# EasyEDA Pro project Archive.eprj, board ALU2.0
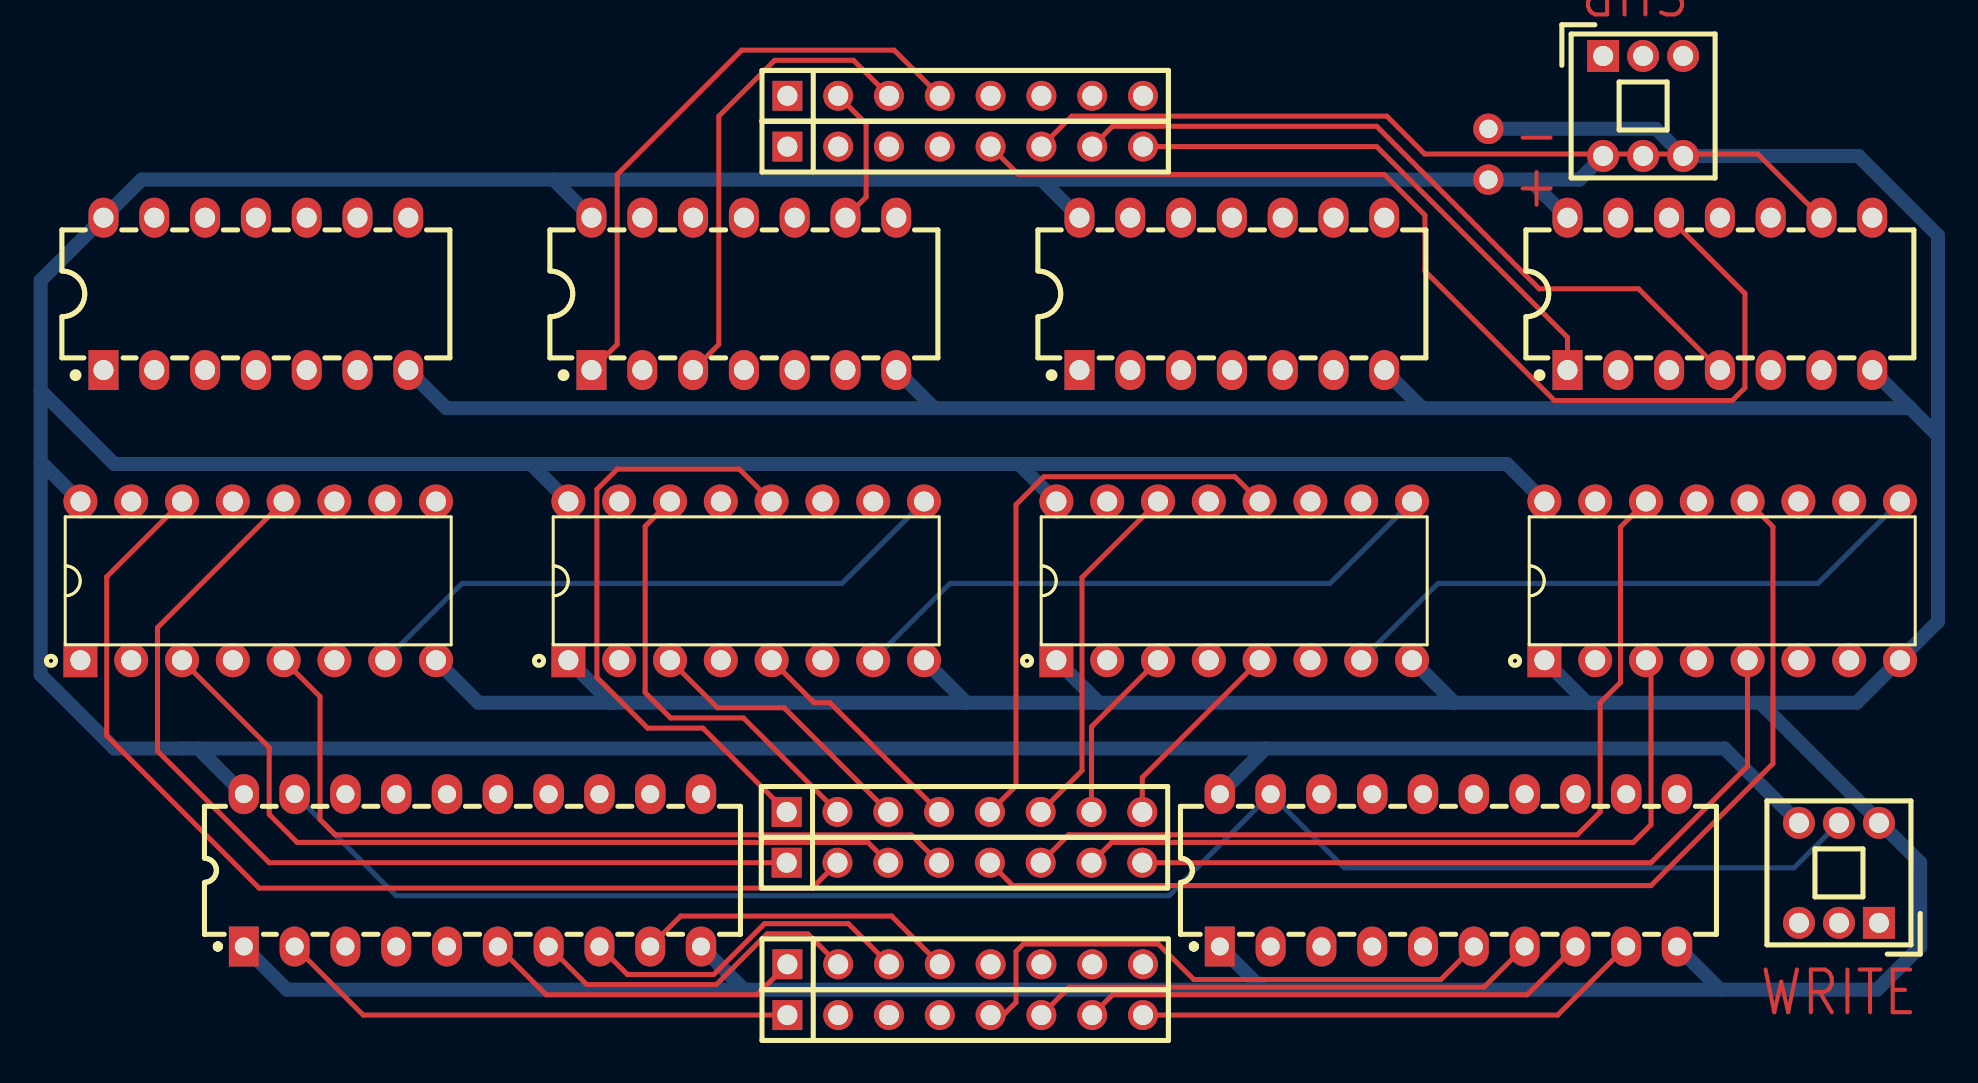
[diagram p14: board, top side]
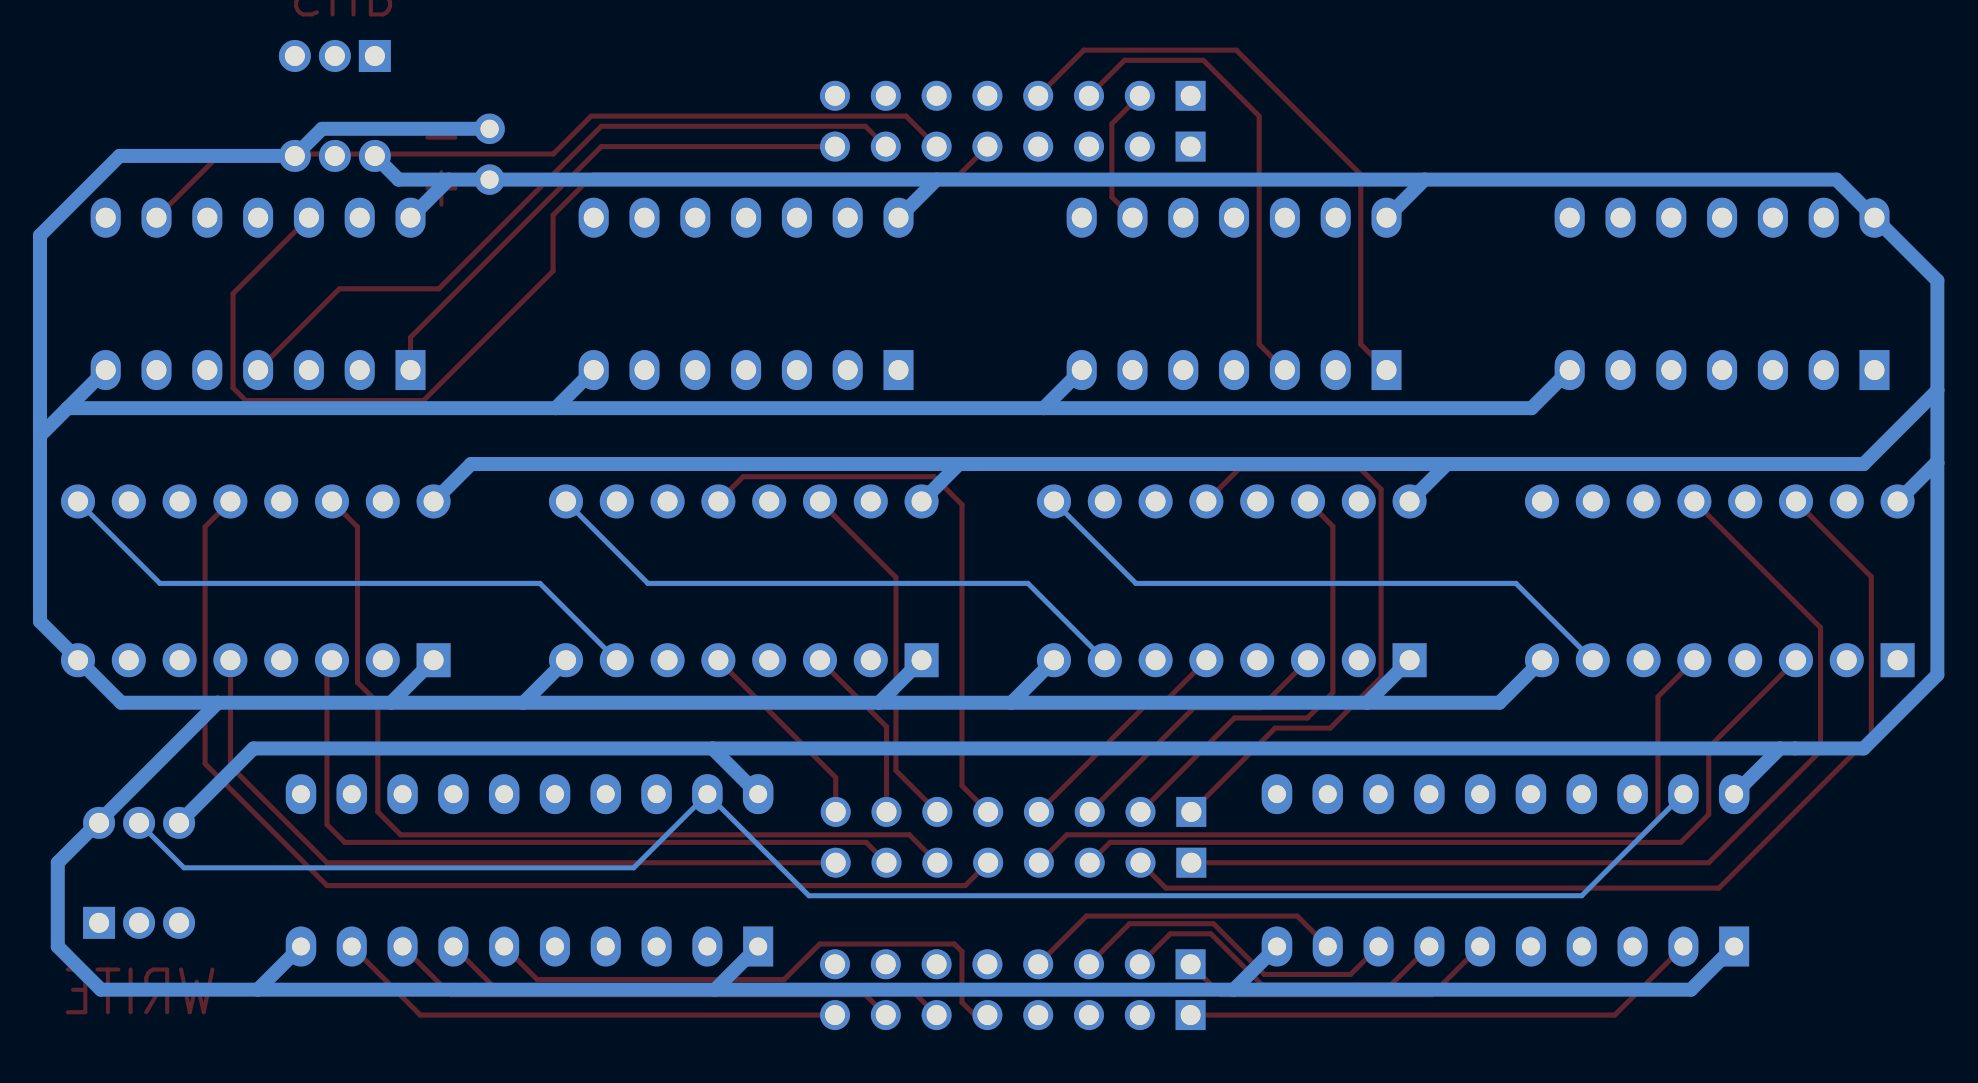
[diagram p15: board, bottom side, seen from below]

No outline. copper layers: Top Layer, Inner1, Inner2, Bottom Layer. Coordinates in mm from the lowest, leftmost part position.
Stack: Top Layer 0.035mm / Dielectric1 1.51mm FR4 er 4.5 / Inner1 0.035mm / Dielectric2 0.48mm PP er 4.5 / Inner2 0.035mm / Dielectric3 0.48mm PP er 4.5 / Bottom Layer 0.035mm

## Design rules (mm)
template: JLCPCB Capability(Two Layers Board)
spacing copperThickness1oz (default): track to track 0.102, other pairs 0.152 to 0.3
spacing copperThickness2oz: track to track 0.203, other pairs 0.152 to 0.3
track width copperThickness1oz (default): min 0.127, default 0.254, max 2.54
track width copperThickness2oz: min 0.203, default 0.254, max 2.54
differential pair differentialPair (default): width min 0.127, default 0.254, max 2.54; gap min 0.152, default 0.152
via viaSize (default): diameter min 0.5, default 0.61, max 10; hole min 0.3, default 0.305, max 6.3

## Placement (name value [footprint] x y rotation side)
NOREF  -  [Pad_e542]  61.63 44.32 270 top
NOREF#2  -  [Pad_e543]  61.63 41.78 270 top
SW2  -  [SW-TH_6P-L7.0-W7.0-P2.00]  69.36 45.47 90 top
SW2#2  -  [SW-TH_6P-L7.0-W7.0-P2.00]  79.15 7.11 270 top
U5  -  [DIP-20_L26.8-W6.4-P2.54-LS7.6-BL]  59.63 7.24 0 top
U5#2  -  [DIP-20_L26.8-W6.4-P2.54-LS7.6-BL]  10.83 7.24 0 top
U10  -  [HDR-TH_8P-P2.54-V-M-4]  35.47 45.97 0 top
U10#2  -  [HDR-TH_8P-P2.54-V-M-4]  35.47 43.43 0 top
U10#3  -  [HDR-TH_8P-P2.54-V-M-4]  35.43 7.62 0 top
U10#4  -  [HDR-TH_8P-P2.54-V-M-4]  35.43 10.16 0 top
U10#5  -  [HDR-TH_8P-P2.54-V-M-4]  35.47 0 0 top
U10#6  -  [HDR-TH_8P-P2.54-V-M-4]  35.47 2.54 0 top
U14  -  [PDIP-14_L19.3-W6.4-P2.54-LS7.9-BL-1]  48.8 36.07 0 top
U14#2  -  [PDIP-14_L19.3-W6.4-P2.54-LS7.9-BL-1]  73.2 36.07 0 top
U14#3  -  [PDIP-14_L19.3-W6.4-P2.54-LS7.9-BL-1]  0 36.07 0 top
U14#4  -  [PDIP-14_L19.3-W6.4-P2.54-LS7.9-BL-1]  24.4 36.07 0 top
U17  -  [DIP-16_L19.3-W6.4-P2.54-LS7.94-BL]  48.92 21.72 0 top
U17#2  -  [DIP-16_L19.3-W6.4-P2.54-LS7.94-BL]  73.32 21.72 0 top
U17#3  -  [DIP-16_L19.3-W6.4-P2.54-LS7.94-BL]  0.12 21.72 0 top
U17#4  -  [DIP-16_L19.3-W6.4-P2.54-LS7.94-BL]  24.52 21.72 0 top

## Footprints (pads in the part's own frame, mm; a bottom-side part is the same pattern mirrored in y, then rotated)
DIP-16_L19.3-W6.4-P2.54-LS7.94-BL
  rect 1.7x1.7 hole 1: 1(-8.89,-3.97)
  round 1.7 hole 1: 2(-6.35,-3.97) 3(-3.81,-3.97) 4(-1.27,-3.97) 5(1.27,-3.97) 6(3.81,-3.97) 7(6.35,-3.97) 8(8.89,-3.97) 9(8.89,3.97) 10(6.35,3.97) 11(3.81,3.97) 12(1.27,3.97) 13(-1.27,3.97) 14(-3.81,3.97) 15(-6.35,3.97) 16(-8.89,3.97)
DIP-20_L26.8-W6.4-P2.54-LS7.6-BL
  rect 1.5x2 hole 0.9: 1(-11.43,-3.81)
  oval 1.5x2 hole 0.9: 2(-8.89,-3.81) 3(-6.35,-3.81) 4(-3.81,-3.81) 5(-1.27,-3.81) 6(1.27,-3.81) 7(3.81,-3.81) 8(6.35,-3.81) 9(8.89,-3.81)
  oval 1.524x2 hole 0.9: 10(11.43,-3.81) 11(11.43,3.81) 12(8.89,3.81) 13(6.35,3.81) 14(3.81,3.81) 15(1.27,3.81) 16(-1.27,3.81) 17(-3.81,3.81) 18(-6.35,3.81) 19(-8.89,3.81) 20(-11.43,3.81)
HDR-TH_8P-P2.54-V-M-4
  rect 1.5x1.5 hole 1: 1(-8.89,0)
  round 1.5 hole 1: 2(-6.35,0) 3(-3.81,0) 4(-1.27,0) 5(1.27,0) 6(3.81,0) 7(6.35,0) 8(8.89,0)
Pad_e542
  round 1.524 hole 0.914: 1(0,0)
Pad_e543
  round 1.524 hole 0.914: 2(0,0)
PDIP-14_L19.3-W6.4-P2.54-LS7.9-BL-1
  rect 1.5x2 hole 1: 1(-7.62,-3.809)
  oval 1.5x2 hole 1: 2(-5.08,-3.81) 3(-2.54,-3.81) 4(0,-3.81) 5(2.54,-3.81) 6(5.08,-3.81) 7(7.62,-3.81) 8(7.62,3.81) 9(5.08,3.81) 10(2.54,3.81) 11(0,3.81) 12(-2.54,3.81) 13(-5.08,3.81) 14(-7.62,3.81)
SW-TH_6P-L7.0-W7.0-P2.00
  rect 1.6x1.6 hole 1: 1(2.499,2)
  round 1.6 hole 1: 2(2.5,0) 3(2.5,-2) 4(-2.5,2) 5(-2.5,0) 6(-2.5,-2)

## Nets

Pads without a net: NOREF 1; NOREF#2 2; SW2 1 2 3 4 5 6; SW2#2 1 2 3 4 5 6; U5 1 2 3 4 5 6 7 8 9 10 11 12 13 14 15 16 17 18 19 20; U5#2 1 2 3 4 5 6 7 8 9 10 11 12 13 14 15 16 17 18 19 20; U10 1 2 3 4 5 6 7 8; U10#2 1 2 3 4 5 6 7 8; U10#3 1 2 3 4 5 6 7 8; U10#4 1 2 3 4 5 6 7 8; U10#5 1 2 3 4 5 6 7 8; U10#6 1 2 3 4 5 6 7 8; U14 1 2 3 4 5 6 7 8 9 10 11 12 13 14; U14#2 1 2 3 4 5 6 7 8 9 10 11 12 13 14; U14#3 1 2 3 4 5 6 7 8 9 10 11 12 13 14; U14#4 1 2 3 4 5 6 7 8 9 10 11 12 13 14; U17 1 2 3 4 5 6 7 8 9 10 11 12 13 14 15 16; U17#2 1 2 3 4 5 6 7 8 9 10 11 12 13 14 15 16; U17#3 1 2 3 4 5 6 7 8 9 10 11 12 13 14 15 16; U17#4 1 2 3 4 5 6 7 8 9 10 11 12 13 14 15 16

## Routing (per net, layer and track width the routed paths; a pad name or vN(x,y) marks a point on that pad's centre or on a via; arc(x,y) is an arc through that point)
(no net): length 2885.7
  Top Layer w0.254: U10.4 31.91,48.26 24.29,48.26 18.07,42.04 18.07,33.54 U14#4.1 ; 71.06,10.41 71.04,10.43 ; U10#4.7 41.78,14.42 U17.3 ; U17.14 41.31,21.89 41.31,12.23 U10#4.6 ; U10#5.7 42.83,1.02 63.56,1.02 U5.8 ; U17#4.14 19.46,24.44 19.46,16.13 20.73,14.86 24.38,14.86 U10#4.2 ; U17.12 48.95,26.92 39.4,26.92 38,25.53 38,11.47 U10#4.5 ; U5.7 61.41,1.4 40.67,1.4 U10#5.6 ; U10#2.5 38.13,42.04 56.42,42.04 58.45,40 58.45,37.21 64.93,30.73 73.82,30.73 74.45,31.37 74.45,36.08 70.66,39.88 ; U5.9 65.09,0 U10#5.8 ; U17#3.5 3.21,15.93 3.21,9.78 3.97,9.02 32.76,9.02 U10#3.4 ; U5.6 59.25,1.78 46.9,1.78 45.12,3.56 38.39,3.56 38,3.17 38,0.63 37.37,0 U10#5.5 ; U14#2.9 75.09,43.06 58.44,43.06 56.55,44.96 40.8,44.96 U10#2.6 ; U17.5 44.32,11.88 U10#4.8 ; U14#4.3 23.15,33.54 23.15,44.96 25.94,47.75 29.88,47.75 U10.3 ; 22.26,10.41 22.24,10.43 ; U10#6.4 31.78,4.95 21.24,4.95 U5#2.9 ; 65.98,10.41 65.96,10.43 ; U5#2.8 18.57,2.03 22.89,2.03 25.43,4.57 29.62,4.57 U10#6.3 ; U10#4.3 26.41,15.37 23.09,15.37 U17#4.3 ; U14#2.1 65.58,33.89 56.04,43.43 U10#2.8 ; U10#2.7 42.83,44.45 56.04,44.45 64.17,36.32 69.14,36.32 U14#2.4 ; U5#2.17 7.02,10.41 ; U10#3.5 37.84,6.48 69.75,6.48 75.85,12.57 75.85,24.42 U17#2.12 ; U10#6.2 27.59,4.06 25.56,4.06 23.02,1.52 16.54,1.52 U5#2.7 ; U10#5.1 5.37,0 U5#2.2 ; U17#3.3 0.67,13.39 0.67,10.03 2.06,8.64 30.6,8.64 U10#3.3 ; U10#3.1 0.67,7.62 -4.92,13.21 -4.92,19.38 U17#3.12 ; U17#3.14 -7.46,21.92 -7.46,13.97 0.16,6.35 27.81,6.35 U10#3.2 ; U10#3.6 40.64,9.02 66.07,9.02 67.22,10.16 67.22,15.62 68.23,16.64 68.23,24.41 U17#2.14 ; U17#4.12 24.17,27.3 18.07,27.3 17.05,26.29 17.05,16.89 19.59,14.35 22.35,14.35 U10#4.1 ; U17#2.3 69.75,17.5 69.75,9.52 68.87,8.64 42.8,8.64 U10#3.7 ; U5#2.6 14.51,1.02 25.05,1.02 U10#6.1 ; U14#4.9 30.51,40.91 30.51,44.58 U10.2 ; U17#4.5 27.91,15.62 28.7,15.62 U10#4.4 ; 17.18,10.41 17.16,10.43 ; U17#2.5 74.58,17.74 74.58,12.45 69.75,7.62 U10#3.8
  Inner1 w0.254: U17#4.1 19.72,13.66 U5#2.12 ; U5.5 55.69,0.76 46.13,0.76 U10#6.8 ; U17.4 50.66,14.73 57.21,14.73 U5.15 ; U5.17 53.28,13.59 40.42,13.59 38.51,15.49 38.51,19.4 U17.13 ; U5#2.17 4.48,13.59 -8.38,13.59 -10.29,15.49 -10.29,19.4 U17#3.13 ; U10#6.6 40.67,3.94 45.24,3.94 47.66,1.52 51.37,1.52 U5.3 ; U17#2.13 73.31,24.42 73.31,10.92 71.91,9.52 67.5,9.52 U5.13 ; U5.14 65.47,9.02 72.17,9.02 75.85,12.7 75.85,21.87 U17#2.10 ; 14.64,10.41 U5#2.14 16.67,9.02 23.37,9.02 27.05,12.7 27.05,21.87 U17#4.10 ; U17#3.1 -5.12,14.1 6.51,14.1 U5#2.16 ; U10#5.2 27.72,-1.4 9.3,-1.4 U5#2.3 ; U17#4.4 22.26,16.76 U5#2.11 ; U10#2.1 1.02,43.43 U14#3.12 ; U17#3.10 4.97,27.18 -9.14,27.18 -10.79,25.53 -10.79,15.24 -8.64,13.08 2.45,13.08 U5#2.18 4.48,10.41 ; U10#5.3 30.51,1.14 9.3,1.14 U5#2.4 ; U17#4.13 24.51,24.42 24.51,10.92 23.11,9.52 18.7,9.52 U5#2.13 ; U5.18 51.25,13.08 40.16,13.08 38,15.24 38,25.53 39.66,27.18 53.78,27.18 U17.10 ; U5.12 68.52,13.66 U17#2.1 ; 53.88,39.88 46.01,47.75 41.05,47.75 U10.6 ; U10#6.5 39.15,4.95 49.21,4.95 U5.2 ; U14.1 44.86,35.94 44.86,41.66 45.88,42.67 45.88,44.45 U10.8 ; U5.4 53.53,1.14 47.53,1.14 45.12,3.56 42.83,3.56 U10#6.7 ; U10#2.2 27.59,41.91 7.11,41.91 U14#3.9 ; U5.11 71.06,16.76 U17#2.4 ; U5.16 55.31,14.1 43.68,14.1 U17.1 ; U10#2.4 34.2,32.64 32.04,30.48 -5.84,30.48 U14#3.1 ; U10#2.3 30.77,42.54 30.77,38.99 25.81,34.04 -0.76,34.04 U14#3.3 ; U10.7 43.09,47.24 45.75,47.24 47.53,45.47 47.53,38.48 48.8,37.21 U14.4 ; U17#3.4 1.86,14.73 8.41,14.73 U5#2.15 ; U10#5.4 32.67,1.52 11.46,1.52 U5#2.5 ; SW2.5 69.36,38.75 72.17,35.94 76.87,35.94 79.53,33.27 79.53,30.86 80.93,29.46 80.93,19.01 U17#2.7
  Inner2 w0.254: 53.88,32.26 53.86,32.24 53.86,17.02 52.72,15.88 44.44,15.88 U17.2 ; U14#2.8 76.88,35.94 71.91,35.94 69.37,33.4 69.37,28.09 U17#2.15 ; U17#2.2 68.84,15.88 77.12,15.88 78.26,17.02 78.26,32.24 U14#2.6 ; U17#4.6 27.05,19.02 27.05,27.07 U14#4.3 ; U14#4.11 26.43,41.91 32.51,41.91 33.78,40.64 33.78,38.86 28.32,33.4 28.32,25.69 U17#4.11 ; U17.6 51.45,19.02 51.45,27.07 U14.3 ; U14#4.8 28.08,35.94 23.11,35.94 20.57,33.4 20.57,28.09 U17#4.15 ; 70.66,32.26 75.85,27.07 75.85,19.02 U17#2.6 ; U14#3.6 5.06,32.24 5.06,17.02 3.92,15.88 -4.36,15.88 U17#3.2 ; U14#4.6 29.46,32.24 29.46,17.02 28.32,15.88 20.04,15.88 U17#4.2 ; U14#3.8 3.68,35.94 -1.29,35.94 -3.83,33.4 -3.83,28.09 U17#3.15 ; U17#3.6 2.65,19.02 2.65,27.07 U14#3.3 ; U14.11 50.83,41.91 56.91,41.91 58.18,40.64 58.18,38.86 52.72,33.4 52.72,25.69 U17.11 ; U17#3.11 3.92,25.69 3.92,33.4 9.38,38.86 9.38,40.64 8.11,41.91 2.03,41.91 U14#3.11 ; U10.5 38.13,44.58 44.86,44.58 46.26,43.18 U14.12 ; U14#4.12 21.86,41.26 U10.1 ; U14.8 52.48,35.94 47.51,35.94 44.97,33.4 44.97,28.09 U17.15 ; U14#2.11 75.23,41.91 81.31,41.91 82.58,40.64 82.58,38.86 77.12,33.4 77.12,25.69 U17#2.11
  Bottom Layer w0.254: U17#4.9 29.31,21.59 10.31,21.59 U17#3.7 ; U17.9 53.71,21.59 34.71,21.59 U17#4.7 ; U5#2.19 7.02,5.97 45.66,5.97 U5.19 54.42,7.37 76.91,7.37 SW2#2.5 ; U17.7 59.11,21.59 78.11,21.59 U17#2.9
  Bottom Layer w0.7: -2.89,13.33 50.48,13.33 ; -2.89,13.33 -7.08,13.33 -10.76,17.02 -10.76,27.61 ; -2.89,13.33 U5#2.20 ; 50.48,13.33 73.43,13.33 SW2#2.6 ; 50.48,13.33 U5.20 ; -10.76,31.24 -10.76,27.61 ; -10.76,31.24 -10.76,36.73 U14#3.14 -5.72,41.78 14.88,41.78 ; -10.76,31.24 -7.08,27.56 13.75,27.56 ; -10.76,27.61 -10.7,27.61 U17#3.16 ; U17#4.1 17.75,15.62 ; 17.75,15.62 11.13,15.62 U17#3.8 ; 17.75,15.62 35.53,15.62 ; 39.28,41.78 NOREF#2.2 63.68,41.78 ; 39.28,41.78 14.88,41.78 ; 39.28,41.78 U14.14 ; U14#4.7 33.93,30.35 ; 33.93,30.35 9.53,30.35 U14#3.7 ; 33.93,30.35 58.33,30.35 ; SW2.4 66.18,41.78 63.68,41.78 ; U5#2.10 24.42,1.27 ; 24.42,1.27 1.56,1.27 U5#2.1 ; 24.42,1.27 50.36,1.27 ; 50.36,1.27 73.22,1.27 ; 50.36,1.27 U5.1 ; 73.22,1.27 U5.10 ; 73.22,1.27 81.06,1.27 83.22,3.43 83.22,7.62 75.22,15.62 ; 42.15,15.62 59.93,15.62 ; 42.15,15.62 U17.1 ; 42.15,15.62 35.53,15.62 ; 59.93,15.62 U17.8 ; 59.93,15.62 66.55,15.62 ; NOREF.1 70.01,44.32 SW2.6 80.13,42.97 84.11,38.99 84.11,28.97 ; 75.22,15.62 80.04,15.62 84.11,19.68 84.11,28.97 ; 75.22,15.62 66.55,15.62 ; 35.53,15.62 U17#4.8 ; 63.68,41.78 U14#2.14 ; 66.55,15.62 U17#2.1 ; U17#4.16 13.75,27.56 ; 13.75,27.56 38.15,27.56 ; 58.33,30.35 82.73,30.35 ; 58.33,30.35 U14.7 ; 82.73,30.35 84.11,28.97 ; 82.73,30.35 U14#2.7 ; U14#4.14 14.88,41.78 ; 38.15,27.56 62.55,27.56 U17#2.16 ; 38.15,27.56 U17.16

## Text on the board
Top Layer: - | + | WRITE | SUB
